# EasyEDA Pro project kuafu01_030内部老化方案.eprj, board PCB4 (continued)
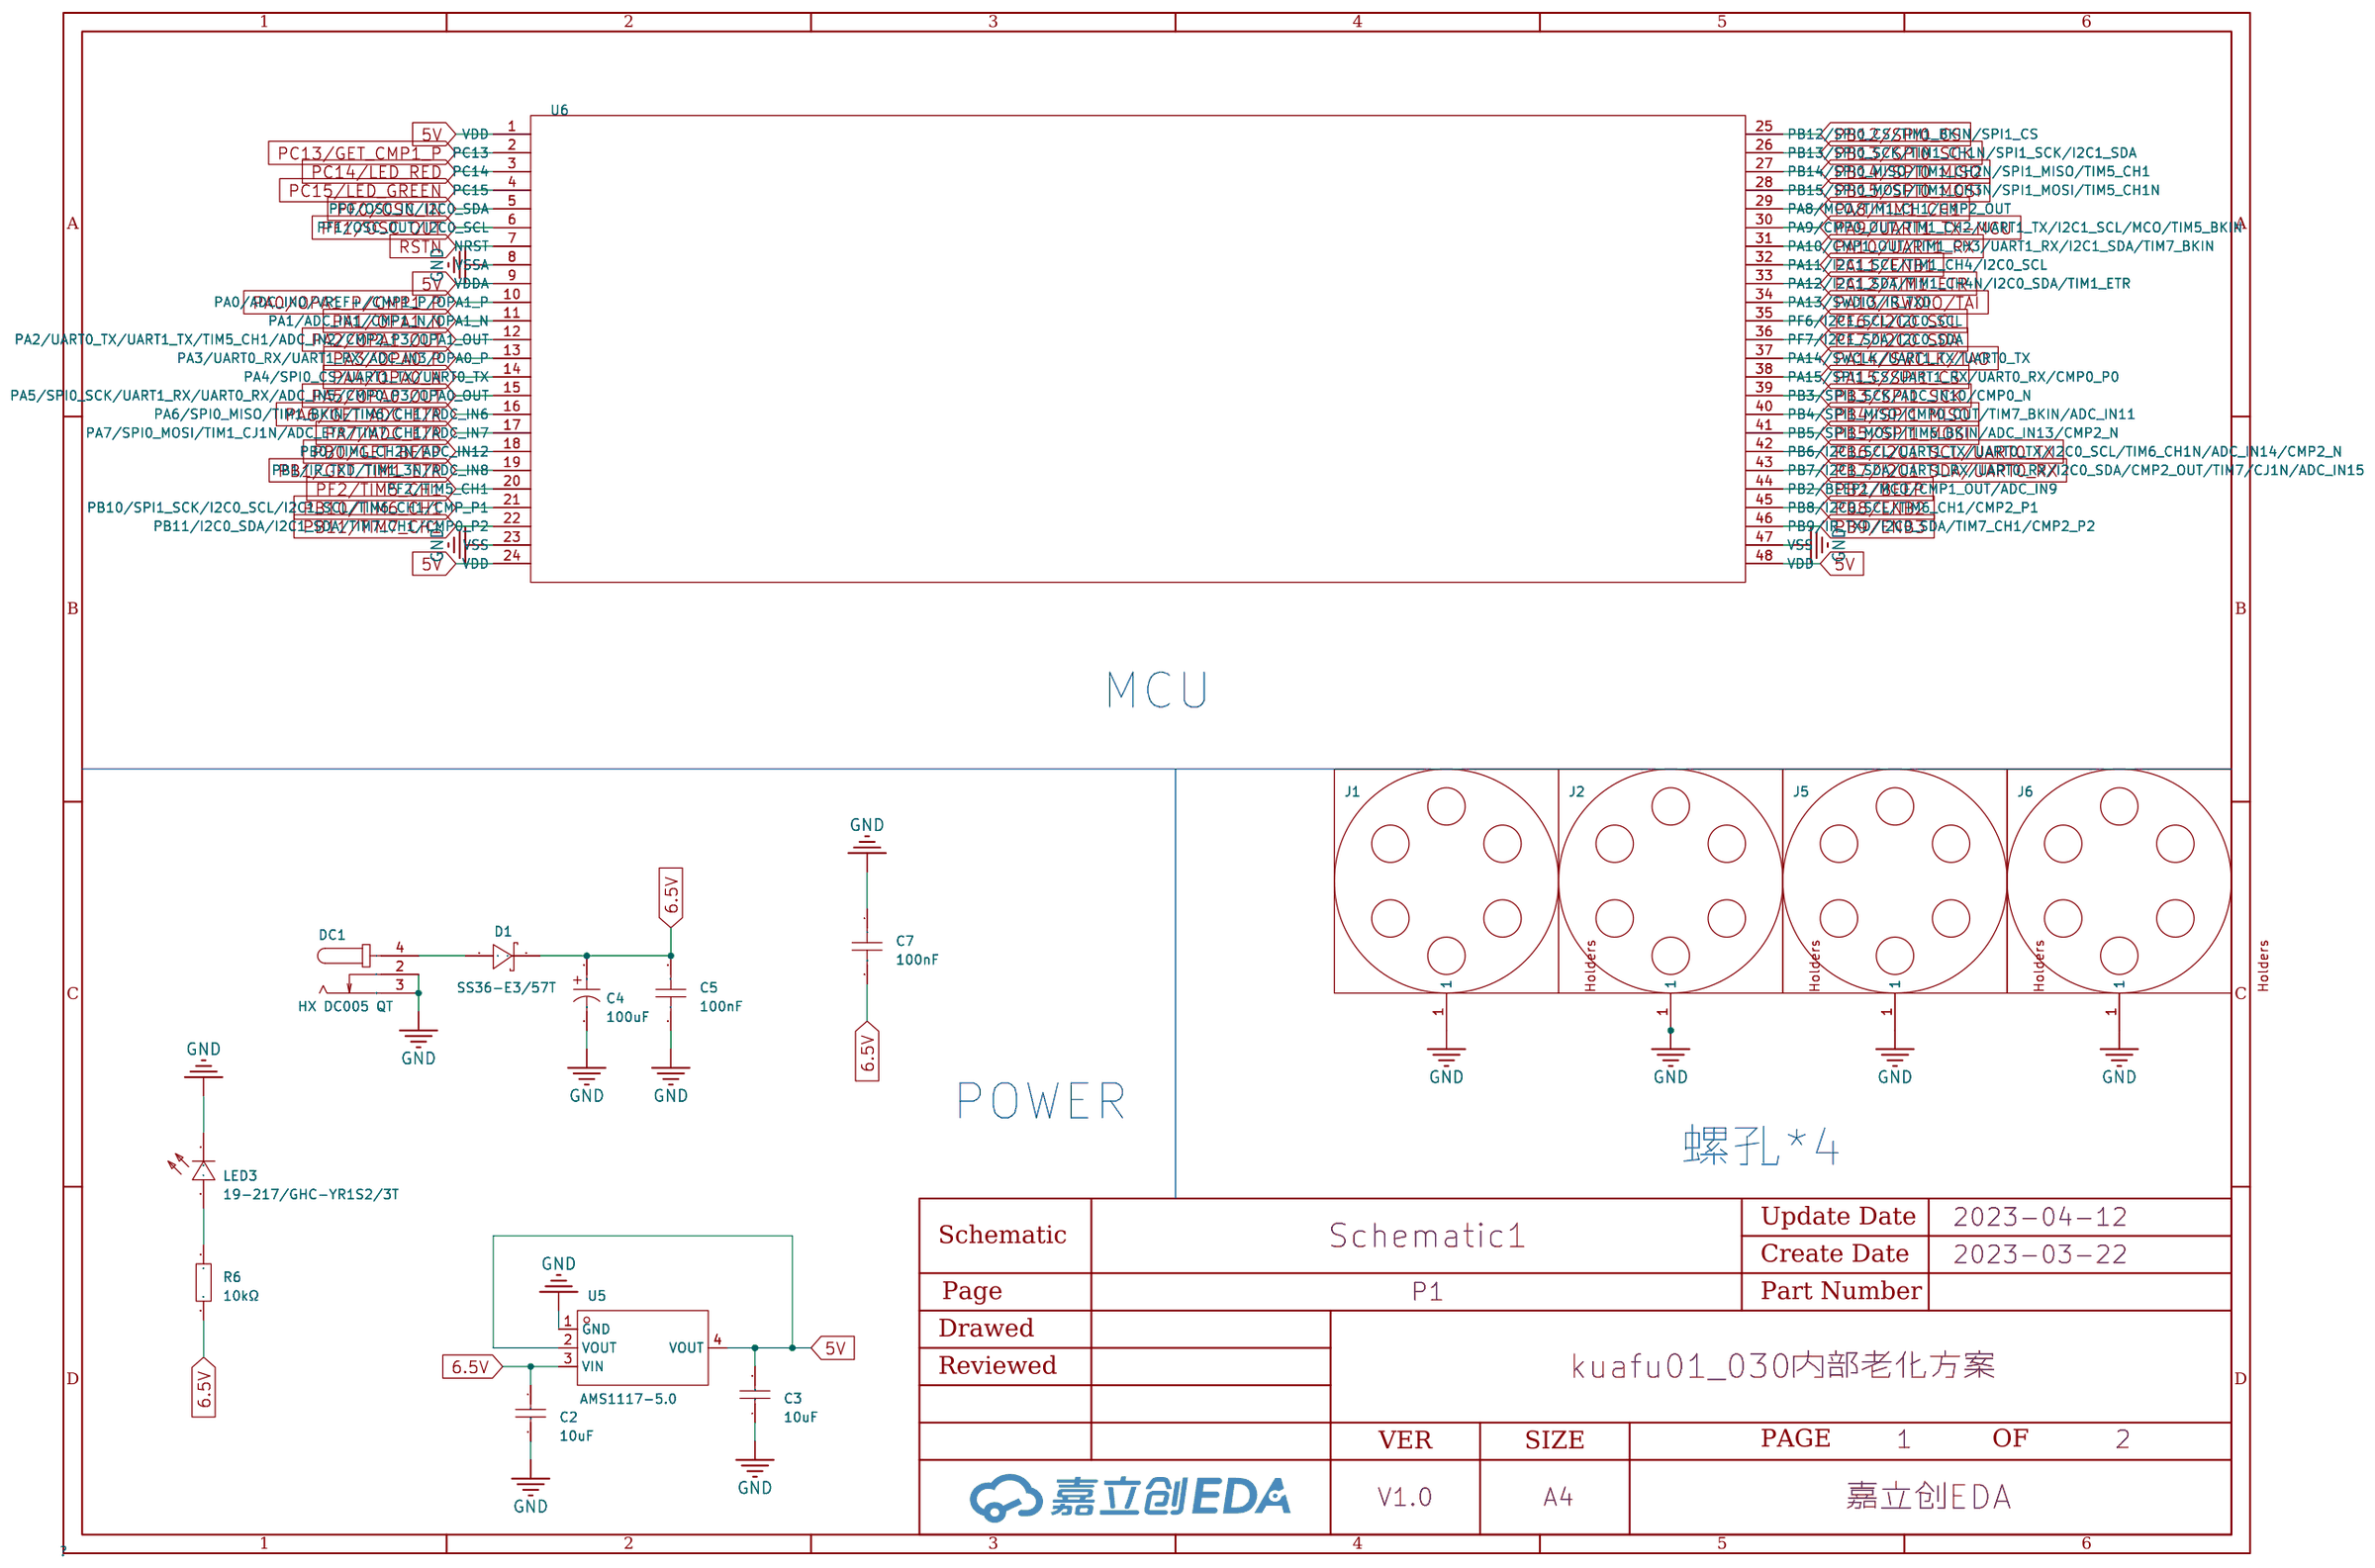
[diagram p0: P1]
## Routing (per net, layer and track width the routed paths; a pad name or vN(x,y) marks a point on that pad's centre or on a via; arc(x,y) is an arc through that point) (continued)
  Bottom Layer w0.254: v1(47.9,239.06) 48.47,239.64 58.08,239.64 64.19,233.52 64.19,233.17 v1(64.11,233.08) ; v1(200.3,35.86) 200.87,36.44 210.48,36.44 216.59,30.32 216.59,29.97 v1(216.51,29.88) ; v1(149.5,35.86) 150.07,36.44 159.68,36.44 165.79,30.32 165.79,29.97 v1(165.71,29.88) ; v1(47.9,289.86) 48.47,290.44 58.08,290.44 64.19,284.32 64.19,283.97 v1(64.11,283.88) ; v1(64.11,182.28) 64.19,182.37 64.19,182.72 58.08,188.84 48.47,188.84 v1(47.9,188.26) ; v1(98.7,239.06) 99.27,239.64 108.88,239.64 114.99,233.52 114.99,233.17 v1(114.91,233.08) ; v1(251.1,239.06) 251.67,239.64 261.28,239.64 267.39,233.52 267.39,233.17 v1(267.31,233.08) ; v1(251.1,340.66) 251.67,341.24 261.28,341.24 267.39,335.12 267.39,334.77 v1(267.31,334.68) ; v1(200.3,137.46) 200.87,138.04 210.48,138.04 216.59,131.92 216.59,131.57 v1(216.51,131.48) ; v1(47.9,86.66) 48.47,87.24 58.08,87.24 64.19,81.12 64.19,80.77 v1(64.11,80.68) ; v1(114.91,182.28) 114.99,182.37 114.99,182.72 108.88,188.84 99.27,188.84 v1(98.7,188.26) ; v1(216.51,283.88) 216.59,283.97 216.59,284.32 210.48,290.44 200.87,290.44 v1(200.3,289.86) ; v1(200.3,188.26) 200.87,188.84 210.48,188.84 216.59,182.72 216.59,182.37 v1(216.51,182.28) ; v1(318.11,80.68) 318.19,80.77 318.19,81.12 312.08,87.24 302.47,87.24 v1(301.9,86.66) ; v1(301.9,137.46) 302.47,138.04 312.08,138.04 318.19,131.92 318.19,131.57 v1(318.11,131.48) ; v1(47.9,137.46) 48.47,138.04 58.08,138.04 64.19,131.92 64.19,131.57 v1(64.11,131.48) ; v1(114.91,131.48) 114.99,131.57 114.99,131.92 108.88,138.04 99.27,138.04 v1(98.7,137.46) ; v1(114.91,29.88) 114.99,29.97 114.99,30.32 108.88,36.44 99.27,36.44 v1(98.7,35.86) ; v1(267.31,131.48) 267.39,131.57 267.39,131.92 261.28,138.04 251.67,138.04 v1(251.1,137.46) ; v1(98.7,340.66) 99.27,341.24 108.88,341.24 114.99,335.12 114.99,334.77 v1(114.91,334.68) ; v1(165.71,131.48) 165.79,131.57 165.79,131.92 159.68,138.04 150.07,138.04 v1(149.5,137.46) ; v1(165.71,233.08) 165.79,233.17 165.79,233.52 159.68,239.64 150.07,239.64 v1(149.5,239.06) ; v1(251.1,289.86) 251.67,290.44 261.28,290.44 267.39,284.32 267.39,283.97 v1(267.31,283.88) ; v1(114.91,80.68) 114.99,80.77 114.99,81.12 108.88,87.24 99.27,87.24 v1(98.7,86.66) ; v1(98.7,289.86) 99.27,290.44 108.88,290.44 114.99,284.32 114.99,283.97 v1(114.91,283.88) ; v1(200.3,340.66) 200.87,341.24 210.48,341.24 216.59,335.12 216.59,334.77 v1(216.51,334.68) ; v1(216.51,80.68) 216.59,80.77 216.59,81.12 210.48,87.24 200.87,87.24 v1(200.3,86.66) ; v1(318.11,233.08) 318.19,233.17 318.19,233.52 312.08,239.64 302.47,239.64 v1(301.9,239.06) ; v1(267.31,182.28) 267.39,182.37 267.39,182.72 261.28,188.84 251.67,188.84 v1(251.1,188.26) ; v1(216.51,233.08) 216.59,233.17 216.59,233.52 210.48,239.64 200.87,239.64 v1(200.3,239.06) ; v1(267.31,29.88) 267.39,29.97 267.39,30.32 261.28,36.44 251.67,36.44 v1(251.1,35.86) ; v1(318.11,283.88) 318.19,283.97 318.19,284.32 312.08,290.44 302.47,290.44 v1(301.9,289.86) ; v1(165.71,334.68) 165.79,334.77 165.79,335.12 159.68,341.24 150.07,341.24 v1(149.5,340.66) ; v1(251.1,86.66) 251.67,87.24 261.28,87.24 267.39,81.12 267.39,80.77 v1(267.31,80.68) ; v1(165.71,80.68) 165.79,80.77 165.79,81.12 159.68,87.24 150.07,87.24 v1(149.5,86.66) ; v1(301.9,188.26) 302.47,188.84 312.08,188.84 318.19,182.72 318.19,182.37 v1(318.11,182.28) ; v1(318.11,334.68) 318.19,334.77 318.19,335.12 312.08,341.24 302.47,341.24 v1(301.9,340.66) ; v1(149.5,188.26) 150.07,188.84 159.68,188.84 165.79,182.72 165.79,182.37 v1(165.71,182.28) ; v1(47.9,35.86) 48.47,36.44 58.08,36.44 64.19,30.32 64.19,29.97 v1(64.11,29.88) ; v1(165.71,283.88) 165.79,283.97 165.79,284.32 159.68,290.44 150.07,290.44 v1(149.5,289.86)
PA14/SWCLK/TAO: length 1223.9
  Top Layer w0.254: 105.19,81.78 105.17,81.8 105.17,82.47 106.37,82.47 v1(106.95,83.05) ; v1(208.55,83.05) 207.97,82.47 206.77,82.47 206.77,81.8 206.79,81.78 ; v1(97.6,45.23) 95.86,43.49 95.86,40.88 96.47,40.28 98.59,40.28 99.85,39.02 ; v1(310.15,184.65) 309.57,184.07 308.37,184.07 308.37,183.4 308.39,183.38 ; v1(250,96.03) 248.27,94.29 248.27,91.68 248.87,91.08 250.99,91.08 252.25,89.82 ; v1(201.38,238.81) 201.42,238.84 201.42,242.14 ; v1(148.4,197.63) 146.66,195.89 146.66,193.28 147.27,192.68 149.39,192.68 150.65,191.42 ; 105.19,183.38 105.17,183.4 105.17,184.07 106.37,184.07 v1(106.95,184.65) ; v1(201.38,137.2) 201.42,137.24 201.42,140.54 ; 201.45,293.02 200.19,294.28 198.07,294.28 197.47,294.88 197.47,297.49 v1(199.2,299.23) ; 257.59,284.98 257.57,285 257.57,285.67 258.77,285.67 v1(259.35,286.25) ; v1(150.58,238.81) 150.62,238.84 150.62,242.14 ; v1(106.95,235.45) 106.37,234.87 105.17,234.87 105.17,234.2 105.19,234.18 ; v1(300.8,197.63) 299.06,195.89 299.06,193.28 299.67,192.68 301.79,192.68 303.05,191.42 ; 257.59,183.38 257.57,183.4 257.57,184.07 258.77,184.07 v1(259.35,184.65) ; v1(302.98,289.6) 303.02,289.64 303.02,292.94 ; 303.02,89.74 303.02,86.44 v1(302.98,86.41) ; 252.25,293.02 250.99,294.28 248.87,294.28 248.27,294.88 248.27,297.49 v1(250,299.23) ; v1(56.15,286.25) 55.57,285.67 54.37,285.67 54.37,285 54.39,284.98 ; v1(310.15,133.85) 309.57,133.27 308.37,133.27 308.37,132.6 308.39,132.58 ; v1(157.75,133.85) 157.17,133.27 155.97,133.27 155.97,132.6 155.99,132.58 ; 99.82,140.54 99.82,137.24 v1(99.78,137.2) ; v1(252.18,188) 252.22,188.04 252.22,191.34 ; 49.02,38.94 49.02,35.64 v1(48.98,35.6) ; v1(150.58,86.41) 150.62,86.44 150.62,89.74 ; v1(97.6,350.03) 95.86,348.29 95.86,345.68 96.47,345.08 98.59,345.08 99.85,343.82 ; 99.82,191.34 99.82,188.04 v1(99.78,188) ; 155.99,81.78 155.97,81.8 155.97,82.47 157.17,82.47 v1(157.75,83.05) ; 155.99,183.38 155.97,183.4 155.97,184.07 157.17,184.07 v1(157.75,184.65) ; 105.19,30.98 105.17,31 105.17,31.67 106.37,31.67 v1(106.95,32.25) ; v1(250,248.43) 248.27,246.69 248.27,244.08 248.87,243.48 250.99,243.48 252.25,242.22 ; v1(106.95,337.05) 106.37,336.47 105.17,336.47 105.17,335.8 105.19,335.78 ; 150.65,242.22 149.39,243.48 147.27,243.48 146.66,244.08 146.66,246.69 v1(148.4,248.43) ; 303.05,89.82 301.79,91.08 299.67,91.08 299.06,91.68 299.06,94.29 v1(300.8,96.03) ; v1(150.58,340.4) 150.62,340.44 150.62,343.74 ; v1(48.98,289.6) 49.02,289.64 49.02,292.94 ; 49.02,89.74 49.02,86.44 v1(48.98,86.41) ; 201.45,343.82 200.19,345.08 198.07,345.08 197.47,345.68 197.47,348.29 v1(199.2,350.03) ; 303.05,293.02 301.79,294.28 299.67,294.28 299.06,294.88 299.06,297.49 v1(300.8,299.23) ; v1(199.2,45.23) 197.47,43.49 197.47,40.88 198.07,40.28 200.19,40.28 201.45,39.02 ; 49.05,242.22 47.79,243.48 45.67,243.48 45.06,244.08 45.06,246.69 v1(46.8,248.43) ; v1(97.6,197.63) 95.86,195.89 95.86,193.28 96.47,192.68 98.59,192.68 99.85,191.42 ; 201.45,89.82 200.19,91.08 198.07,91.08 197.47,91.68 197.47,94.29 v1(199.2,96.03) ; 308.39,234.18 308.37,234.2 308.37,234.87 309.57,234.87 v1(310.15,235.45) ; v1(148.4,45.23) 146.66,43.49 146.66,40.88 147.27,40.28 149.39,40.28 150.65,39.02 ; v1(48.98,137.2) 49.02,137.24 49.02,140.54 ; v1(201.38,35.6) 201.42,35.64 201.42,38.94 ; 99.82,38.94 99.82,35.64 v1(99.78,35.6) ; 303.05,343.82 301.79,345.08 299.67,345.08 299.06,345.68 299.06,348.29 v1(300.8,350.03) ; v1(56.15,235.45) 55.57,234.87 54.37,234.87 54.37,234.2 54.39,234.18 ; v1(201.38,289.6) 201.42,289.64 201.42,292.94 ; 99.85,89.82 98.59,91.08 96.47,91.08 95.86,91.68 95.86,94.29 v1(97.6,96.03) ; 252.22,242.14 252.22,238.84 v1(252.18,238.81) ; 49.02,242.14 49.02,238.84 v1(48.98,238.81) ; v1(259.35,235.45) 258.77,234.87 257.57,234.87 257.57,234.2 257.59,234.18 ; v1(97.6,146.83) 95.86,145.09 95.86,142.48 96.47,141.88 98.59,141.88 99.85,140.62 ; v1(302.98,137.2) 303.02,137.24 303.02,140.54 ; 303.05,140.62 301.79,141.88 299.67,141.88 299.06,142.48 299.06,145.09 v1(300.8,146.83) ; 308.39,81.78 308.37,81.8 308.37,82.47 309.57,82.47 v1(310.15,83.05) ; 303.05,242.22 301.79,243.48 299.67,243.48 299.06,244.08 299.06,246.69 v1(300.8,248.43) ; 206.79,183.38 206.77,183.4 206.77,184.07 207.97,184.07 v1(208.55,184.65) ; 54.39,81.78 54.37,81.8 54.37,82.47 55.57,82.47 v1(56.15,83.05) ; v1(99.78,289.6) 99.82,289.64 99.82,292.94 ; 206.79,335.78 206.77,335.8 206.77,336.47 207.97,336.47 v1(208.55,337.05) ; 99.85,242.22 98.59,243.48 96.47,243.48 95.86,244.08 95.86,246.69 v1(97.6,248.43) ; 155.99,284.98 155.97,285 155.97,285.67 157.17,285.67 v1(157.75,286.25) ; 201.45,242.22 200.19,243.48 198.07,243.48 197.47,244.08 197.47,246.69 v1(199.2,248.43) ; v1(150.58,289.6) 150.62,289.64 150.62,292.94 ; v1(310.15,286.25) 309.57,285.67 308.37,285.67 308.37,285 308.39,284.98 ; 54.39,132.58 54.37,132.6 54.37,133.27 55.57,133.27 v1(56.15,133.85) ; 99.82,89.74 99.82,86.44 v1(99.78,86.41) ; 257.59,132.58 257.57,132.6 257.57,133.27 258.77,133.27 v1(259.35,133.85) ; v1(201.38,86.41) 201.42,86.44 201.42,89.74 ; v1(208.55,235.45) 207.97,234.87 206.77,234.87 206.77,234.2 206.79,234.18 ; v1(148.4,146.83) 146.66,145.09 146.66,142.48 147.27,141.88 149.39,141.88 150.65,140.62 ; 201.45,140.62 200.19,141.88 198.07,141.88 197.47,142.48 197.47,145.09 v1(199.2,146.83) ; v1(302.98,340.4) 303.02,340.44 303.02,343.74 ; 150.62,140.54 150.62,137.24 v1(150.58,137.2) ; v1(250,45.23) 248.27,43.49 248.27,40.88 248.87,40.28 250.99,40.28 252.25,39.02 ; v1(259.35,83.05) 258.77,82.47 257.57,82.47 257.57,81.8 257.59,81.78 ; v1(148.4,299.23) 146.66,297.49 146.66,294.88 147.27,294.28 149.39,294.28 150.65,293.02 ; v1(259.35,32.25) 258.77,31.67 257.57,31.67 257.57,31 257.59,30.98 ; 308.39,335.78 308.37,335.8 308.37,336.47 309.57,336.47 v1(310.15,337.05) ; 105.19,284.98 105.17,285 105.17,285.67 106.37,285.67 v1(106.95,286.25) ; 150.62,191.34 150.62,188.04 v1(150.58,188) ; 49.05,39.02 47.79,40.28 45.67,40.28 45.06,40.88 45.06,43.49 v1(46.8,45.23) ; v1(46.8,96.03) 45.06,94.29 45.06,91.68 45.67,91.08 47.79,91.08 49.05,89.82 ; 54.39,183.38 54.37,183.4 54.37,184.07 55.57,184.07 v1(56.15,184.65) ; v1(199.2,197.63) 197.47,195.89 197.47,193.28 198.07,192.68 200.19,192.68 201.45,191.42 ; v1(201.38,340.4) 201.42,340.44 201.42,343.74 ; 252.22,292.94 252.22,289.64 v1(252.18,289.6) ; 303.02,191.34 303.02,188.04 v1(302.98,188) ; v1(250,197.63) 248.27,195.89 248.27,193.28 248.87,192.68 250.99,192.68 252.25,191.42 ; 99.82,343.74 99.82,340.44 v1(99.78,340.4) ; 303.02,242.14 303.02,238.84 v1(302.98,238.81) ; 201.42,191.34 201.42,188.04 v1(201.38,188) ; v1(56.15,32.25) 55.57,31.67 54.37,31.67 54.37,31 54.39,30.98 ; v1(150.58,35.6) 150.62,35.64 150.62,38.94 ; v1(252.18,35.6) 252.22,35.64 252.22,38.94 ; v1(106.95,133.85) 106.37,133.27 105.17,133.27 105.17,132.6 105.19,132.58 ; 206.79,132.58 206.77,132.6 206.77,133.27 207.97,133.27 v1(208.55,133.85) ; v1(252.18,340.4) 252.22,340.44 252.22,343.74 ; 252.25,343.82 250.99,345.08 248.87,345.08 248.27,345.68 248.27,348.29 v1(250,350.03) ; v1(99.78,238.81) 99.82,238.84 99.82,242.14 ; 49.05,191.42 47.79,192.68 45.67,192.68 45.06,193.28 45.06,195.89 v1(46.8,197.63) ; v1(157.75,235.45) 157.17,234.87 155.97,234.87 155.97,234.2 155.99,234.18 ; 49.05,140.62 47.79,141.88 45.67,141.88 45.06,142.48 45.06,145.09 v1(46.8,146.83) ; 155.99,30.98 155.97,31 155.97,31.67 157.17,31.67 v1(157.75,32.25) ; 206.79,30.98 206.77,31 206.77,31.67 207.97,31.67 v1(208.55,32.25) ; 252.22,140.54 252.22,137.24 v1(252.18,137.2) ; 49.05,293.02 47.79,294.28 45.67,294.28 45.06,294.88 45.06,297.49 v1(46.8,299.23) ; 257.59,335.78 257.57,335.8 257.57,336.47 258.77,336.47 v1(259.35,337.05) ; 252.25,140.62 250.99,141.88 248.87,141.88 248.27,142.48 248.27,145.09 v1(250,146.83) ; v1(148.4,96.03) 146.66,94.29 146.66,91.68 147.27,91.08 149.39,91.08 150.65,89.82 ; 49.02,191.34 49.02,188.04 v1(48.98,188) ; 252.22,89.74 252.22,86.44 v1(252.18,86.41) ; v1(97.6,299.23) 95.86,297.49 95.86,294.88 96.47,294.28 98.59,294.28 99.85,293.02 ; 150.65,343.82 149.39,345.08 147.27,345.08 146.66,345.68 146.66,348.29 v1(148.4,350.03) ; v1(208.55,286.25) 207.97,285.67 206.77,285.67 206.77,285 206.79,284.98 ; v1(157.75,337.05) 157.17,336.47 155.97,336.47 155.97,335.8 155.99,335.78
  Top Layer w0.381: 101.17,252.56 98.83,250.22 v1(97.91,250.22) ; v1(148.71,301.02) 149.63,301.02 151.97,303.37 ; v1(301.11,148.62) 302.03,148.62 304.37,150.97 ; v1(301.11,351.82) 302.03,351.82 304.37,354.16 ; v1(97.91,301.02) 98.83,301.02 101.17,303.37 ; v1(47.11,47.02) 48.03,47.02 50.37,49.36 ; 50.37,100.16 48.03,97.82 v1(47.11,97.82) ; v1(199.51,301.02) 200.43,301.02 202.77,303.37 ; v1(250.31,97.82) 251.23,97.82 253.57,100.16 ; v1(47.11,148.62) 48.03,148.62 50.37,150.97 ; 202.77,354.16 200.43,351.82 v1(199.51,351.82) ; v1(47.11,250.22) 48.03,250.22 50.37,252.56 ; 253.57,49.36 251.23,47.02 v1(250.31,47.02) ; 202.77,201.76 200.43,199.42 v1(199.51,199.42) ; 151.97,354.16 149.63,351.82 v1(148.71,351.82) ; 253.57,252.56 251.23,250.22 v1(250.31,250.22) ; v1(250.31,301.02) 251.23,301.02 253.57,303.37 ; 202.77,100.16 200.43,97.82 v1(199.51,97.82) ; v1(47.11,301.02) 48.03,301.02 50.37,303.37 ; v1(199.51,47.02) 200.43,47.02 202.77,49.36 ; 253.57,150.97 251.23,148.62 v1(250.31,148.62) ; v1(148.71,47.02) 149.63,47.02 151.97,49.36 ; 151.97,100.16 149.63,97.82 v1(148.71,97.82) ; v1(301.11,301.02) 302.03,301.02 304.37,303.37 ; v1(250.31,351.82) 251.23,351.82 253.57,354.16 ; v1(199.51,250.22) 200.43,250.22 202.77,252.56 ; 151.97,150.97 149.63,148.62 v1(148.71,148.62) ; 304.37,201.76 302.03,199.42 v1(301.11,199.42) ; 101.17,150.97 98.83,148.62 v1(97.91,148.62) ; v1(199.51,148.62) 200.43,148.62 202.77,150.97 ; 304.37,100.16 302.03,97.82 v1(301.11,97.82) ; v1(301.11,250.22) 302.03,250.22 304.37,252.56 ; v1(148.71,199.42) 149.63,199.42 151.97,201.76 ; v1(250.31,199.42) 251.23,199.42 253.57,201.76 ; v1(97.91,351.82) 98.83,351.82 101.17,354.16 ; 101.17,49.36 98.83,47.02 v1(97.91,47.02) ; v1(97.91,97.82) 98.83,97.82 101.17,100.16 ; v1(97.91,199.42) 98.83,199.42 101.17,201.76 ; 151.97,252.56 149.63,250.22 v1(148.71,250.22) ; v1(47.11,199.42) 48.03,199.42 50.37,201.76
  Bottom Layer w0.254: v1(201.38,289.6) 201.97,289.01 205.79,289.01 v1(208.55,286.25) ; v1(259.35,133.85) 256.59,136.61 252.77,136.61 v1(252.18,137.2) ; v1(99.78,238.81) 100.37,238.21 104.19,238.21 v1(106.95,235.45) ; v1(201.38,238.81) 201.97,238.21 205.79,238.21 v1(208.55,235.45) ; v1(99.78,35.6) 100.37,35.01 104.19,35.01 v1(106.95,32.25) ; v1(302.98,86.41) 303.57,85.81 307.39,85.81 v1(310.15,83.05) ; v1(310.15,133.85) 307.39,136.61 303.57,136.61 v1(302.98,137.2) ; v1(157.75,286.25) 154.99,289.01 151.17,289.01 v1(150.58,289.6) ; v1(252.18,340.4) 252.77,339.81 256.59,339.81 v1(259.35,337.05) ; v1(259.35,286.25) 256.59,289.01 252.77,289.01 v1(252.18,289.6) ; v1(150.58,188) 151.17,187.41 154.99,187.41 v1(157.75,184.65) ; v1(99.78,289.6) 100.37,289.01 104.19,289.01 v1(106.95,286.25) ; v1(157.75,337.05) 154.99,339.81 151.17,339.81 v1(150.58,340.4) ; v1(106.95,133.85) 104.19,136.61 100.37,136.61 v1(99.78,137.2) ; v1(99.78,86.41) 100.37,85.81 104.19,85.81 v1(106.95,83.05) ; v1(208.55,83.05) 205.79,85.81 201.97,85.81 v1(201.38,86.41) ; v1(48.98,188) 49.57,187.41 53.39,187.41 v1(56.15,184.65) ; v1(157.75,32.25) 154.99,35.01 151.17,35.01 v1(150.58,35.6) ; v1(56.15,235.45) 53.39,238.21 49.57,238.21 v1(48.98,238.81) ; v1(252.18,35.6) 252.77,35.01 256.59,35.01 v1(259.35,32.25) ; v1(48.98,289.6) 49.57,289.01 53.39,289.01 v1(56.15,286.25) ; v1(150.58,86.41) 151.17,85.81 154.99,85.81 v1(157.75,83.05) ; v1(56.15,32.25) 53.39,35.01 49.57,35.01 v1(48.98,35.6) ; v1(302.98,238.81) 303.57,238.21 307.39,238.21 v1(310.15,235.45) ; v1(302.98,289.6) 303.57,289.01 307.39,289.01 v1(310.15,286.25) ; v1(208.55,337.05) 205.79,339.81 201.97,339.81 v1(201.38,340.4) ; v1(208.55,184.65) 205.79,187.41 201.97,187.41 v1(201.38,188) ; v1(157.75,133.85) 154.99,136.61 151.17,136.61 v1(150.58,137.2) ; v1(157.75,235.45) 154.99,238.21 151.17,238.21 v1(150.58,238.81) ; v1(259.35,184.65) 256.59,187.41 252.77,187.41 v1(252.18,188) ; v1(310.15,337.05) 307.39,339.81 303.57,339.81 v1(302.98,340.4) ; v1(208.55,133.85) 205.79,136.61 201.97,136.61 v1(201.38,137.2) ; v1(201.38,35.6) 201.97,35.01 205.79,35.01 v1(208.55,32.25) ; v1(56.15,133.85) 53.39,136.61 49.57,136.61 v1(48.98,137.2) ; v1(302.98,188) 303.57,187.41 307.39,187.41 v1(310.15,184.65) ; v1(252.18,238.81) 252.77,238.21 256.59,238.21 v1(259.35,235.45) ; v1(48.98,86.41) 49.57,85.81 53.39,85.81 v1(56.15,83.05) ; v1(252.18,86.41) 252.77,85.81 256.59,85.81 v1(259.35,83.05) ; v1(99.78,188) 100.37,187.41 104.19,187.41 v1(106.95,184.65) ; v1(99.78,340.4) 100.37,339.81 104.19,339.81 v1(106.95,337.05)
  Bottom Layer w0.381: v1(97.91,47.02) 97.91,45.53 v1(97.6,45.23) ; v1(300.8,96.03) 301.11,96.33 v1(301.11,97.82) ; v1(97.6,197.63) 97.91,197.93 v1(97.91,199.42) ; v1(250.31,148.62) 250.31,147.13 v1(250,146.83) ; v1(300.8,248.43) 301.11,248.73 v1(301.11,250.22) ; v1(47.11,301.02) 47.11,299.53 v1(46.8,299.23) ; v1(47.11,199.42) 47.11,197.93 v1(46.8,197.63) ; v1(199.51,47.02) 199.51,45.53 v1(199.2,45.23) ; v1(97.6,248.43) 97.91,248.73 v1(97.91,250.22) ; v1(250.31,301.02) 250.31,299.53 v1(250,299.23) ; v1(199.2,350.03) 199.51,350.33 v1(199.51,351.82) ; v1(250.31,199.42) 250.31,197.93 v1(250,197.63) ; v1(97.91,97.82) 97.91,96.33 v1(97.6,96.03) ; v1(250.31,97.82) 250.31,96.33 v1(250,96.03) ; v1(97.6,350.03) 97.91,350.33 v1(97.91,351.82) ; v1(46.8,146.83) 47.11,147.13 v1(47.11,148.62) ; v1(199.51,97.82) 199.51,96.33 v1(199.2,96.03) ; v1(250,45.23) 250.31,45.53 v1(250.31,47.02) ; v1(250.31,250.22) 250.31,248.73 v1(250,248.43) ; v1(148.4,146.83) 148.71,147.13 v1(148.71,148.62) ; v1(148.4,96.03) 148.71,96.33 v1(148.71,97.82) ; v1(199.51,148.62) 199.51,147.13 v1(199.2,146.83) ; v1(46.8,248.43) 47.11,248.73 v1(47.11,250.22) ; v1(46.8,45.23) 47.11,45.53 v1(47.11,47.02) ; v1(300.8,146.83) 301.11,147.13 v1(301.11,148.62) ; v1(300.8,299.23) 301.11,299.53 v1(301.11,301.02) ; v1(199.2,197.63) 199.51,197.93 v1(199.51,199.42) ; v1(301.11,351.82) 301.11,350.33 v1(300.8,350.03) ; v1(148.4,197.63) 148.71,197.93 v1(148.71,199.42) ; v1(301.11,199.42) 301.11,197.93 v1(300.8,197.63) ; v1(199.2,299.23) 199.51,299.53 v1(199.51,301.02) ; v1(47.11,97.82) 47.11,96.33 v1(46.8,96.03) ; v1(148.4,45.23) 148.71,45.53 v1(148.71,47.02) ; v1(148.71,250.22) 148.71,248.73 v1(148.4,248.43) ; v1(97.91,301.02) 97.91,299.53 v1(97.6,299.23) ; v1(148.4,350.03) 148.71,350.33 v1(148.71,351.82) ; v1(148.71,301.02) 148.71,299.53 v1(148.4,299.23) ; v1(250.31,351.82) 250.31,350.33 v1(250,350.03) ; v1(199.2,248.43) 199.51,248.73 v1(199.51,250.22) ; v1(97.6,146.83) 97.91,147.13 v1(97.91,148.62)
PA15/SPI1_CS: length 1451.5
  Top Layer w0.254: 259.03,176.4 259.04,176.4 270.02,176.4 273,179.38 273,180.86 268.21,185.65 257.71,185.65 257.08,185.01 257.08,183.56 ; 259.03,278 259.04,278 270.02,278 273,280.98 273,282.46 268.21,287.25 257.71,287.25 257.08,286.61 257.08,285.16 ; 157.43,176.4 157.44,176.4 168.42,176.4 171.4,179.38 171.4,180.86 166.61,185.65 156.11,185.65 155.48,185.01 155.48,183.56 ; 104.68,335.96 104.68,337.41 105.31,338.05 115.81,338.05 120.6,333.26 120.6,331.78 117.62,328.8 106.64,328.8 106.63,328.8 ; 155.48,132.76 155.48,134.21 156.11,134.85 166.61,134.85 171.4,130.06 171.4,128.58 168.42,125.6 157.44,125.6 157.43,125.6 ; 155.48,335.96 155.48,337.41 156.11,338.05 166.61,338.05 171.4,333.26 171.4,331.78 168.42,328.8 157.44,328.8 157.43,328.8 ; 155.48,31.16 155.48,32.61 156.11,33.25 166.61,33.25 171.4,28.46 171.4,26.98 168.42,24 157.44,24 157.43,24 ; 257.08,335.96 257.08,337.41 257.71,338.05 268.21,338.05 273,333.26 273,331.78 270.02,328.8 259.04,328.8 259.03,328.8 ; 208.23,227.2 208.24,227.2 219.22,227.2 222.2,230.18 222.2,231.66 217.41,236.45 206.91,236.45 206.28,235.81 206.28,234.36 ; 155.48,285.16 155.48,286.61 156.11,287.25 166.61,287.25 171.4,282.46 171.4,280.98 168.42,278 157.44,278 157.43,278 ; 104.68,132.76 104.68,134.21 105.31,134.85 115.81,134.85 120.6,130.06 120.6,128.58 117.62,125.6 106.64,125.6 106.63,125.6 ; 53.88,132.76 53.88,134.21 54.51,134.85 65.01,134.85 69.8,130.06 69.8,128.58 66.82,125.6 55.84,125.6 55.83,125.6 ; 104.68,31.16 104.68,32.61 105.31,33.25 115.81,33.25 120.6,28.46 120.6,26.98 117.62,24 106.64,24 106.63,24 ; 206.28,335.96 206.28,337.41 206.91,338.05 217.41,338.05 222.2,333.26 222.2,331.78 219.22,328.8 208.24,328.8 208.23,328.8 ; 307.88,234.36 307.88,235.81 308.51,236.45 319.01,236.45 323.8,231.66 323.8,230.18 320.82,227.2 309.84,227.2 309.83,227.2 ; 55.83,278 55.84,278 66.82,278 69.8,280.98 69.8,282.46 65.01,287.25 54.51,287.25 53.88,286.61 53.88,285.16 ; 259.03,125.6 259.04,125.6 270.02,125.6 273,128.58 273,130.06 268.21,134.85 257.71,134.85 257.08,134.21 257.08,132.76 ; 206.28,183.56 206.28,185.01 206.91,185.65 217.41,185.65 222.2,180.86 222.2,179.38 219.22,176.4 208.24,176.4 208.23,176.4 ; 157.43,227.2 157.44,227.2 168.42,227.2 171.4,230.18 171.4,231.66 166.61,236.45 156.11,236.45 155.48,235.81 155.48,234.36 ; 208.23,74.8 208.24,74.8 219.22,74.8 222.2,77.78 222.2,79.26 217.41,84.05 206.91,84.05 206.28,83.41 206.28,81.96 ; 208.23,125.6 208.24,125.6 219.22,125.6 222.2,128.58 222.2,130.06 217.41,134.85 206.91,134.85 206.28,134.21 206.28,132.76 ; 53.88,234.36 53.88,235.81 54.51,236.45 65.01,236.45 69.8,231.66 69.8,230.18 66.82,227.2 55.84,227.2 55.83,227.2 ; 55.83,24 55.84,24 66.82,24 69.8,26.98 69.8,28.46 65.01,33.25 54.51,33.25 53.88,32.61 53.88,31.16 ; 106.63,278 106.64,278 117.62,278 120.6,280.98 120.6,282.46 115.81,287.25 105.31,287.25 104.68,286.61 104.68,285.16 ; 106.63,176.4 106.64,176.4 117.62,176.4 120.6,179.38 120.6,180.86 115.81,185.65 105.31,185.65 104.68,185.01 104.68,183.56 ; 206.28,285.16 206.28,286.61 206.91,287.25 217.41,287.25 222.2,282.46 222.2,280.98 219.22,278 208.24,278 208.23,278 ; 257.08,31.16 257.08,32.61 257.71,33.25 268.21,33.25 273,28.46 273,26.98 270.02,24 259.04,24 259.03,24 ; 259.03,74.8 259.04,74.8 270.02,74.8 273,77.78 273,79.26 268.21,84.05 257.71,84.05 257.08,83.41 257.08,81.96 ; 307.88,183.56 307.88,185.01 308.51,185.65 319.01,185.65 323.8,180.86 323.8,179.38 320.82,176.4 309.84,176.4 309.83,176.4 ; 307.88,132.76 307.88,134.21 308.51,134.85 319.01,134.85 323.8,130.06 323.8,128.58 320.82,125.6 309.84,125.6 309.83,125.6 ; 208.23,24 208.24,24 219.22,24 222.2,26.98 222.2,28.46 217.41,33.25 206.91,33.25 206.28,32.61 206.28,31.16 ; 53.88,81.96 53.88,83.41 54.51,84.05 65.01,84.05 69.8,79.26 69.8,77.78 66.82,74.8 55.84,74.8 55.83,74.8 ; 53.88,183.56 53.88,185.01 54.51,185.65 65.01,185.65 69.8,180.86 69.8,179.38 66.82,176.4 55.84,176.4 55.83,176.4 ; 106.63,227.2 106.64,227.2 117.62,227.2 120.6,230.18 120.6,231.66 115.81,236.45 105.31,236.45 104.68,235.81 104.68,234.36 ; 309.83,328.8 309.84,328.8 320.82,328.8 323.8,331.78 323.8,333.26 319.01,338.05 308.51,338.05 307.88,337.41 307.88,335.96 ; 307.88,81.96 307.88,83.41 308.51,84.05 319.01,84.05 323.8,79.26 323.8,77.78 320.82,74.8 309.84,74.8 309.83,74.8 ; 155.48,81.96 155.48,83.41 156.11,84.05 166.61,84.05 171.4,79.26 171.4,77.78 168.42,74.8 157.44,74.8 157.43,74.8 ; 257.08,234.36 257.08,235.81 257.71,236.45 268.21,236.45 273,231.66 273,230.18 270.02,227.2 259.04,227.2 259.03,227.2 ; 106.63,74.8 106.64,74.8 117.62,74.8 120.6,77.78 120.6,79.26 115.81,84.05 105.31,84.05 104.68,83.41 104.68,81.96 ; 307.88,285.16 307.88,286.61 308.51,287.25 319.01,287.25 323.8,282.46 323.8,280.98 320.82,278 309.84,278 309.83,278
